# EasyEDA Pro project balance_car.eprj, board PCB2
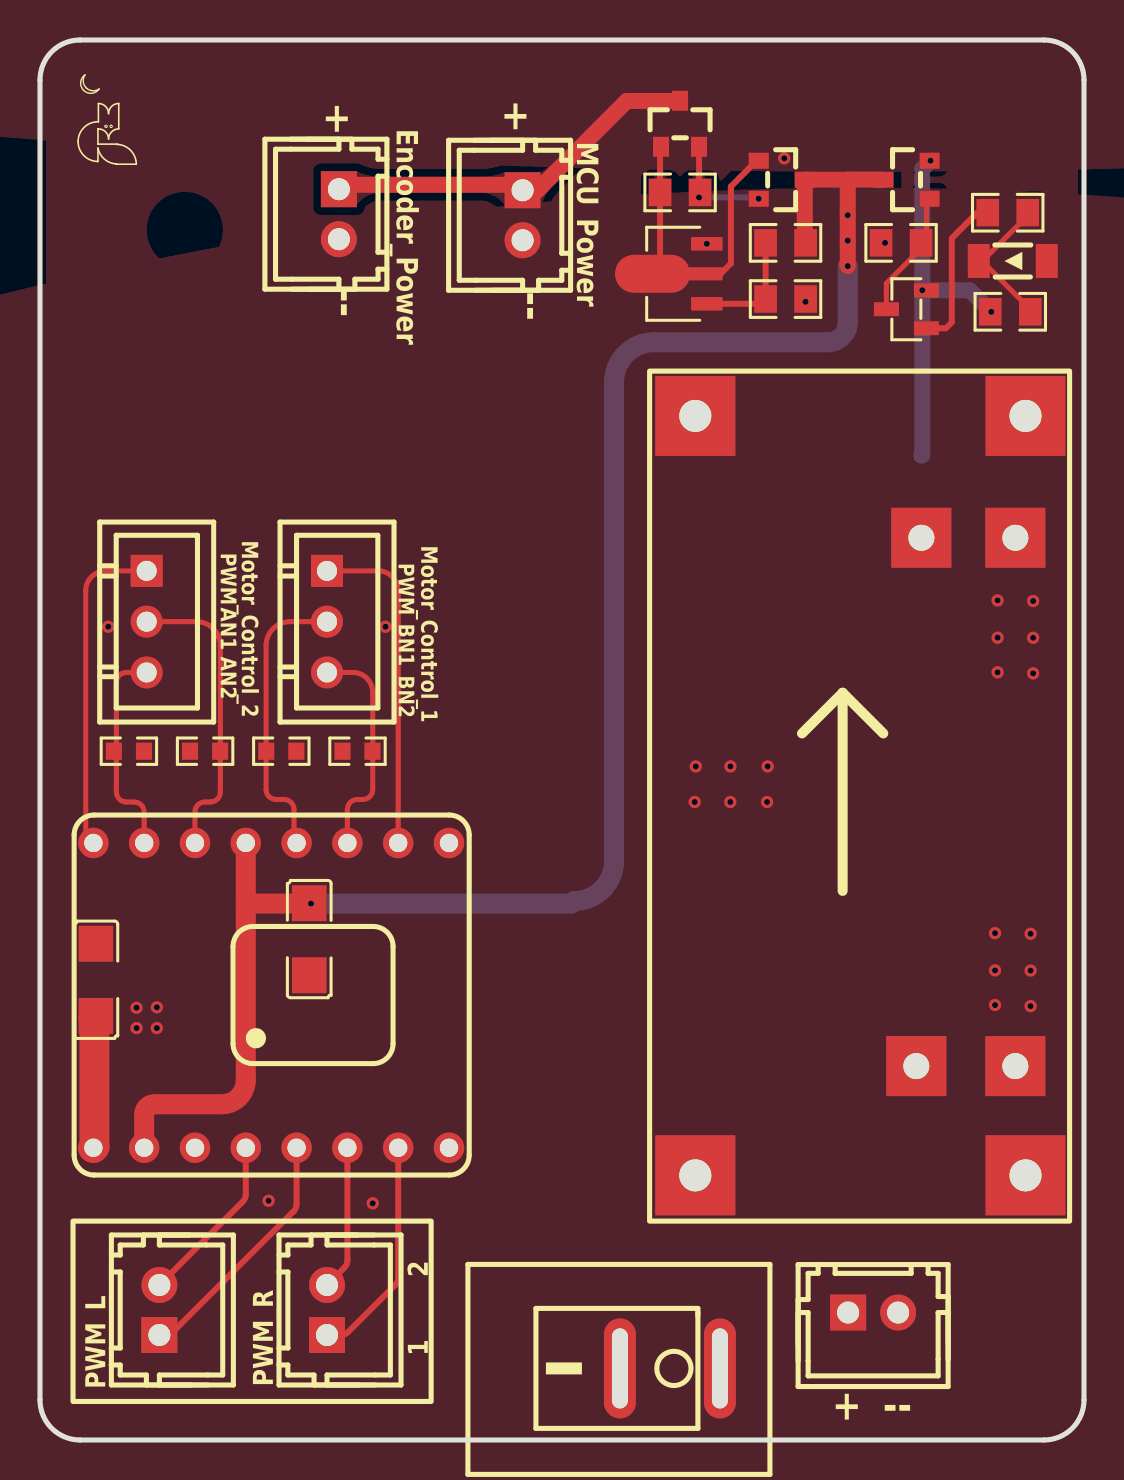
[diagram p4: board, top side]
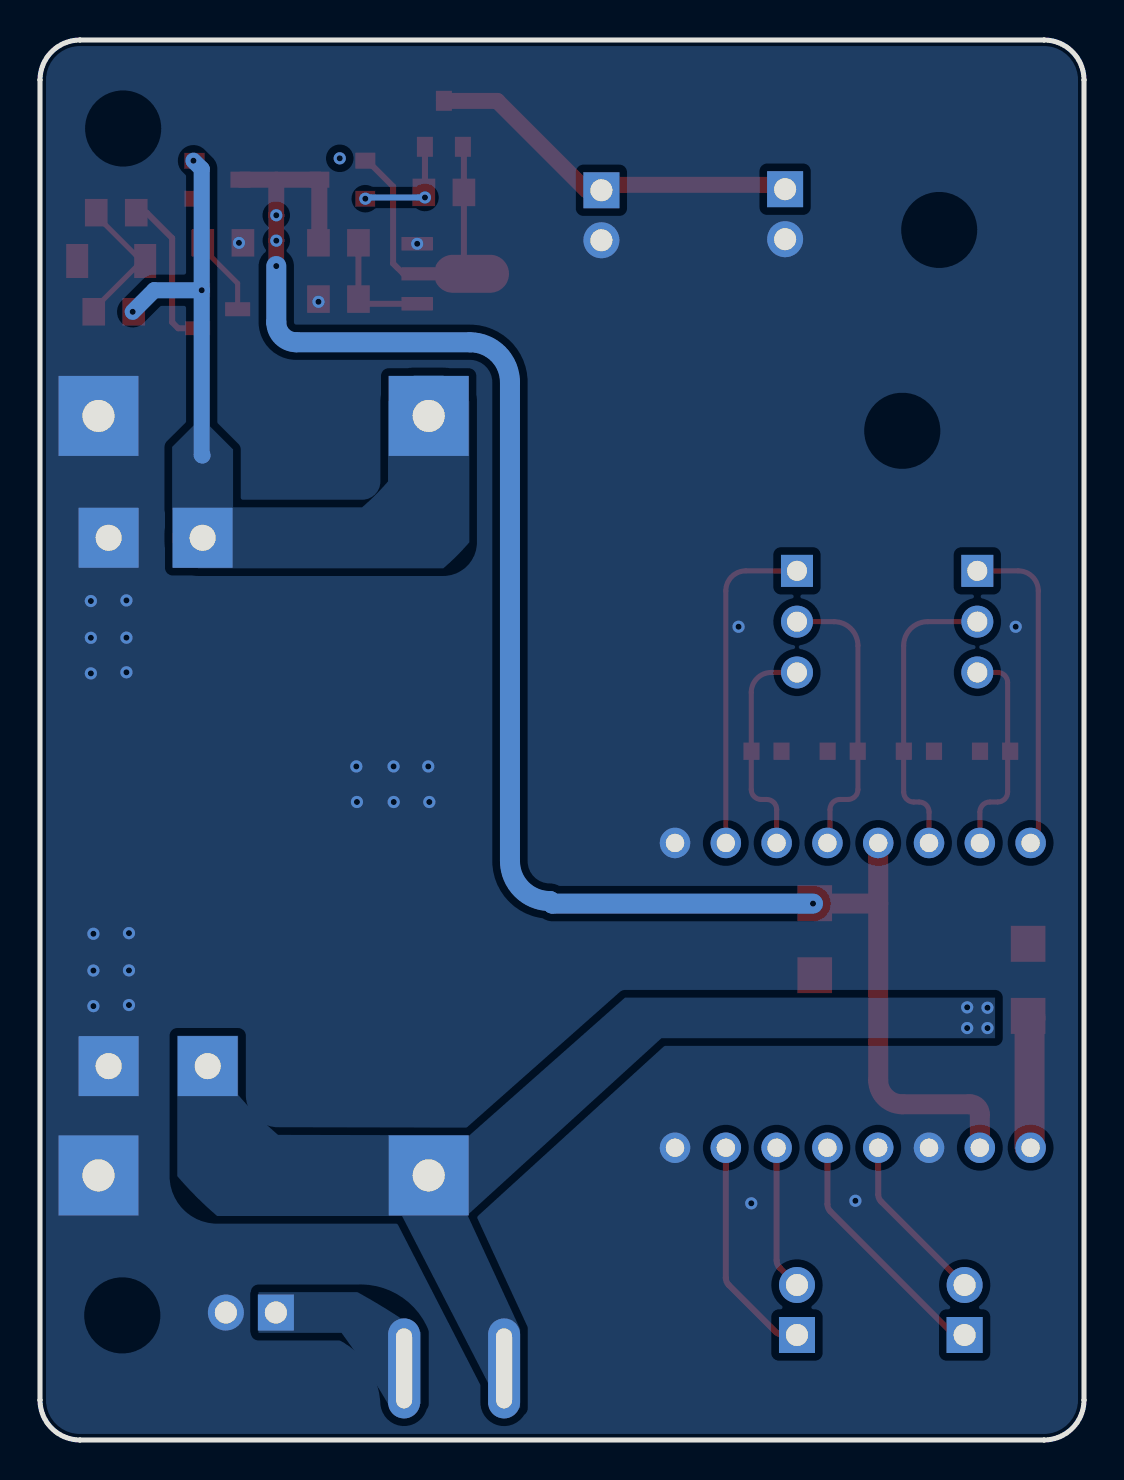
[diagram p5: board, bottom side, seen from below]

Outline 52.2 x 70 mm; copper layers: Top Layer, Bottom Layer. Coordinates in mm from the lower left corner of the outline.
Outline path: 0,68 0,2 arc(0.59,0.59) 2,0 50.2,0 arc(51.61,0.59) 52.2,2 52.2,68 arc(51.61,69.41) 50.2,70 2,70 arc(0.59,69.41) 0,68
Stack: Top Layer 0.035mm / Dielectric1 1.51mm FR4 er 4.5 / Bottom Layer 0.035mm

## Design rules (mm)
template: 自定义配置
spacing copperThickness1oz (default): track to track 0.102, other pairs 0.152 to 0.3
spacing copperThickness2oz: track to track 0.203, other pairs 0.152 to 0.3
track width copperThickness1oz (default): min 0.2, default 0.254, max 0.3
track width copperThickness2oz: min 0.5, default 1.5, max 2.5
differential pair differentialPair (default): width min 0.127, default 0.254, max 2.54; gap min 0.152, default 0.152
via viaSize (default): diameter min 0.5, default 0.61, max 10; hole min 0.3, default 0.305, max 6.3
net GND uses copperThickness2oz
net 7.4V uses copperThickness2oz
net VCC_OUT uses copperThickness2oz
net 7.4V_IN uses copperThickness2oz
net VCC_OUT_2 uses copperThickness2oz
net VCC_OUT_0 uses copperThickness2oz

## Placement (name value [footprint] x y rotation side)
C1  100nF  [C1206]  2.79 23.01 90 top
C2  100nF  [C1206]  13.46 25.04 90 top
CN1  ZX-XH2.54-2PZZ  [CONN-TH_2P-P2.50_HX25003-2A]  24.13 61.24 270 top
CN2  ZX-XH2.54-2PZZ  [CONN-TH_2P-P2.50_HX25003-2A]  5.97 6.5 90 top
CN3  ZX-XH2.54-2PZZ  [CONN-TH_2P-P2.50_HX25003-2A]  14.35 6.5 90 top
CN4  ZX-XH2.54-2PZZ  [CONN-TH_2P-P2.50_HX25003-2A]  41.66 6.37 0 top
CN5  ZX-XH2.54-2PZZ  [CONN-TH_2P-P2.50_HX25003-2A]  14.94 61.29 270 top
NOREF  -  [Pad_e396]  44.07 45.11 270 top
NOREF#2  -  [Pad_e395]  48.77 45.11 270 top
NOREF#3  -  [Pad_e397]  43.81 18.69 270 top
NOREF#4  -  [Pad_e398]  48.77 18.69 270 top
Q1  AO3401A  [SOT-23_L2.9-W1.3-P1.90-LS2.4-BR]  37.08 63.02 180 top
Q2  AO3401A  [SOT-23_L2.9-W1.3-P1.90-LS2.4-BR]  32 65.81 270 top
Q3  AO3401A  [SOT-23_L2.9-W1.3-P1.90-LS2.4-BR]  43.33 63.02 0 top
R1  15kΩ  [R0805]  32 62.38 0 top
R2  15kΩ  [R0805]  37.28 57.05 180 top
R3  1kΩ  [R0805]  37.28 59.86 0 top
R4  47kΩ  [R0805]  48.51 56.41 180 top
R5  10kΩ  [R0805]  43.05 59.86 0 top
R6  4.7kΩ  [R0805]  48.39 61.36 180 top
R7  7.5kΩ  [R0603]  8.25 34.44 0 top
R8  7.5kΩ  [R0603]  4.44 34.44 180 top
R9  7.5kΩ  [R0603]  12.06 34.44 180 top
R10  7.5kΩ  [R0603]  15.88 34.44 0 top
SW1  KCD11-2P-R  [SW-TH_2P-L15.0-W10.5-P5.00_KCD11-2P-R]  31.5 3.58 180 top
U10  ZX-XH2.54-3PZZ  [CONN-TH_3P-P2.54_2501S-3P]  5.33 40.92 270 top
U11  ZX-XH2.54-3PZZ  [CONN-TH_3P-P2.54_2501S-3P]  14.35 40.92 270 top
U12  -  [buck_tb]  39.88 31.9 90 top
U13  D882  [SOT-89-3_L4.5-W2.5-P1.50-LS4.0-BR]  31.98 58.31 0 top
U14  ZMM4V7  [LL-34_L3.5-W1.5-RD]  48.64 58.95 0 top
U15  SS8550  [SOT-23-3_L2.9-W1.3-P1.90-LS2.4-BR]  43.32 56.54 0 top
升压模块1  -  [TB6612FNG]  9.27 22.25 90 top

## Footprints (pads in the part's own frame, mm; a bottom-side part is the same pattern mirrored in y, then rotated)
buck_tb
  rect 4x4 hole 1.6: 1(-18.669,7.112) 2(-18.669,-9.398) 3(19.304,7.112) 4(19.304,-9.398)
C1206
  rect 1.8x1.728 smd: 1(-1.806,0) 2(1.798,0)
CONN-TH_2P-P2.50_HX25003-2A
  rect 1.8x1.8 hole 1.1: 1(-1.25,0)
  round 1.8 hole 1.1: 2(1.25,0)
CONN-TH_3P-P2.54_2501S-3P
  rect 1.6x1.6 hole 1: 1(-2.54,0)
  round 1.6 hole 1: 2(0,0) 3(2.54,0)
LL-34_L3.5-W1.5-RD
  rect 1.1x1.7 smd: 1(-1.7,0) 2(1.7,0)
Pad_e395
  rect 3x3 hole 1.3: 1(0,0)
Pad_e396
  rect 3x3 hole 1.3: 1(0,0)
Pad_e397
  rect 3x3 hole 1.3: 1(0,0)
Pad_e398
  rect 3x3 hole 1.3: 1(0,0)
R0603
  rect 0.806x0.864 smd: 1(-0.753,0) 2(0.753,0)
R0805
  rect 1.133x1.377 smd: 1(-1,0) 2(1,0)
SOT-23-3_L2.9-W1.3-P1.90-LS2.4-BR
  rect 1.25x0.7 smd: 1(1,-0.95) 2(1,0.95) 3(-1,0)
SOT-23_L2.9-W1.3-P1.90-LS2.4-BR
  rect 1x0.8 smd: 1(1.15,-0.95) 2(1.15,0.95) 3(-1.15,0)
SOT-89-3_L4.5-W2.5-P1.50-LS4.0-BR
  rect 1.575x0.672 smd: 1(1.356,-1.5) 3(1.356,1.5)
  custom 5.377x1.9 smd: 2(-1.356,0)
SW-TH_2P-L15.0-W10.5-P5.00_KCD11-2P-R
  oval 1.6x5 hole 0.8x4: 1(-2.5,0) 2(2.5,0)
TB6612FNG
  round 1.524 hole 0.914: 1(-7.636,6.601) 2(-7.636,4.061) 3(-7.636,1.522) 4(-7.636,-1.018) 5(-7.636,-3.558) 6(-7.636,-6.098) 7(-7.636,-8.639) 8(-7.636,-11.178) 9(7.604,6.601) 10(7.604,4.061) 11(7.604,1.522) 12(7.604,-1.018) 13(7.604,-3.558) 14(7.604,-6.098) 15(7.604,-8.639) 16(7.604,-11.178)

## Nets
As in the schematic, except:
7.4V: C1.1 NOREF#3.1 SW1.2 U12.1 升压模块1.1
GND: C1.2 C2.1 CN1.2 CN4.2 CN5.2 NOREF#2.1 NOREF#4.1 R2.1 R5.1 R7.1 R8.1 R9.1 R10.1 U12.2 U12.4 U13.3 U14.2 升压模块1.3 升压模块1.8 升压模块1.16
VCC_OUT_0: NOREF.1 Q3.2 R4.2 U12.3 U15.2

## Via types
v1: diameter 0.61, hole 0.305, Top Layer to Bottom Layer, 39 vias

## Routing (per net, layer and track width the routed paths; a pad name or vN(x,y) marks a point on that pad's centre or on a via; arc(x,y) is an arc through that point)
7.4V: length 6.5
  Top Layer w1.5: 2.67,21.11 2.72,21.05 2.72,14.67 升压模块1.1
  vias: v1(4.83,21.61) v1(4.83,20.6) v1(5.84,21.63) v1(5.84,20.6)
GND:
  vias: v1(3.42,40.66) v1(11.43,11.96) v1(16.64,11.83) v1(17.27,40.66) v1(32.79,33.68) v1(32.74,31.9) v1(33.34,59.81) v1(34.52,33.68) v1(34.51,31.9) v1(36.38,33.68) v1(36.35,31.9) v1(38.28,56.91) v1(42.25,59.86) v1(47.75,25.34) v1(47.75,23.48) v1(47.75,21.75) v1(47.88,41.98) v1(47.88,40.12) v1(47.88,38.38) v1(49.53,25.31) v1(49.53,23.47) v1(49.53,21.69) v1(49.66,41.95) v1(49.66,40.11) v1(49.66,38.33)
VCC_OUT: length 90.8
  Top Layer w0.8: 40.39,63.02 v1(40.39,61.24) v1(40.39,59.97) v1(40.39,58.7) ; 40.39,63.02 Q3.3 ; 40.39,63.02 Q1.3 38.23,59.9 R3.2
  Top Layer w1: 升压模块1.12 10.29,26.82 ; 10.29,26.82 10.29,17.99 arc(9.94,17.14) 9.09,16.79 5.71,16.79 arc(5.36,16.64) 5.21,16.29 升压模块1.2 ; 10.29,26.82 v1(13.55,26.82)
  Bottom Layer w1: v1(40.39,58.7) 40.39,55.89 arc(40.09,55.18) 39.39,54.89 30.7,54.89 arc(29.29,54.3) 28.7,52.89 28.7,28.95 arc(28.12,27.53) 26.7,26.95 26.58,26.82 v1(13.55,26.82)
VCC_OUT_0: length 18.9
  Top Layer w0.8: R4.2 47.52,56.41 v1(47.57,56.41)
  Bottom Layer w0.8: v1(44.11,57.49) 44.11,63.55 v1(44.53,63.97) ; v1(44.11,57.49) 46.49,57.49 v1(47.57,56.41) ; v1(44.11,57.49) 44.11,49.25 44.09,49.23 44.07,49.23
VCC_OUT_2: length 19.1
  Top Layer w0.8: Q2.3 32,66.95 29.34,66.95 24.87,62.49 CN1.1 23.86,62.76 15.17,62.76 CN5.1
(no net):
  vias: v1(37.21,64.08)
MOTOR_L_1: length 8.6
  Top Layer w0.3: CN2.2 10.14,11.92 arc(10.25,12.09) 10.29,12.28 升压模块1.4
MOTOR_L_2: length 12.5
  Top Layer w0.3: 升压模块1.5 12.83,11.79 arc(12.79,11.6) 12.68,11.44 6.64,5.4 arc(6.48,5.29) 6.29,5.25 CN2.1
MOTOR_R_1: length 7.3
  Top Layer w0.3: 升压模块1.6 15.37,8.98 arc(15.33,8.78) 15.22,8.62 CN3.2
MOTOR_R_2: length 11.3
  Top Layer w0.3: 升压模块1.7 17.91,8.11 arc(17.87,7.92) 17.76,7.75 15.41,5.4 arc(15.24,5.29) 15.05,5.25 CN3.1
PA12: length 15.1
  Top Layer w0.254: 7.75,29.85 7.75,31.4 arc(7.89,31.75) 8.25,31.9 8.52,31.9 arc(8.87,32.05) 9.02,32.4 9.02,39.72 arc(8.67,40.57) 7.82,40.92 U10.2
PA15: length 10.8
  Top Layer w0.254: U10.3 4.32,38.38 arc(3.96,38.23) 3.82,37.88 3.82,32.4 arc(3.96,32.05) 4.32,31.9 4.71,31.9 arc(5.06,31.75) 5.21,31.4 5.21,29.85
PB3: length 14.3
  Top Layer w0.254: 升压模块1.13 12.7,29.85 12.7,31.53 arc(12.55,31.88) 12.2,32.03 11.8,32.03 arc(11.45,32.17) 11.3,32.53 11.3,39.72 arc(11.65,40.57) 12.5,40.92 13.97,40.92
PB4: length 11.6
  Top Layer w0.254: 13.97,38.38 15.64,38.38 arc(16.34,38.08) 16.64,37.38 16.64,32.53 arc(16.49,32.17) 16.14,32.03 15.87,32.03 arc(15.51,31.88) 15.37,31.53 15.37,29.85
PB6: length 16.6
  Top Layer w0.254: 5.59,43.46 3.29,43.46 arc(2.58,43.16) 2.29,42.46 2.29,30.24 升压模块1.9
PB7: length 16.7
  Top Layer w0.254: U11.1 16.91,43.46 arc(17.62,43.16) 17.91,42.46 升压模块1.15
$1N2989: length 5.5
  Top Layer w0.3: Q2.2 32.95,64.66 v1(32.95,62.13)
  Bottom Layer w0.3: v1(35.93,62.06) 35.87,62.13 v1(32.95,62.13)
$1N3076: length 15.9
  Top Layer w0.3: U13.2 34.03,58.31 34.54,58.82 34.54,62.67 35.83,63.97 Q1.1 ; Q2.1 31,64.61 R1.1 31,58.69
$1N3246: length 5.8
  Top Layer w0.3: U13.1 36.04,56.81 R2.2 R3.1
$1N4292: length 8.1
  Top Layer w0.3: 47.51,61.36 46.86,61.36 45.59,60.09 45.59,55.89 45.29,55.59 U15.1
$1N4294: length 7.7
  Top Layer w0.254: R4.1 49.51,56.53 47.1,58.95 46.81,58.95 46.81,59.25 47.42,59.25 49.51,61.35 49.51,61.36
$1N4296: length 6.4
  Top Layer w0.254: Q3.1 44.32,61.91 44.32,60.13 R5.2 44.05,59.57 42.32,57.84 U15.3

## Copper pours and planes (outline as drawn; the poured copper is in the pictures)
7.4V on Top Layer: 2.41,22.03 6.22,22.03 6.22,20.21 2.41,20.21
7.4V on Bottom Layer: 4.44,22.12 35.14,22.12 35.14,11.33 4.44,11.33
7.4V on Bottom Layer: 30.73,20.22 45.34,20.22 45.34,11.2 30.73,11.2
7.4V on Bottom Layer: 28.19,15.24 34.8,15.24 34.8,1.59 28.19,1.59
7.4V_IN on Bottom Layer: 33.15,7.39 41.28,7.39 41.28,1.8 33.15,1.8
GND on Top Layer: 0.25,70 52.07,70 52.07,-0.1 0.25,-0.1
GND on Bottom Layer: -0.13,69.75 52.32,69.75 52.32,0.15 -0.13,0.15
VCC_OUT_0 on Bottom Layer: 42.55,51.12 45.59,51.12 45.59,46.5 42.55,46.5
VCC_OUT_0 on Bottom Layer: 30.73,53.24 45.59,53.24 45.59,43.58 30.73,43.58

Small or netless copper shapes (teardrops, artwork), in the pictures only: 65 on Top Layer, 2 on Bottom Layer

## Text on the board
Top Silkscreen Layer: PWM | AN1 | AN2 | BN1 | BN2 | Motor_Control_2 | Motor_Control_1 | PWM_L | PWM_R | 2 | 1 | Encoder_Power | MCU_Power | -- | +
